# EasyEDA Pro project Designs.eprj, schematic Schematic3_3
Board Name: Registers; Create Date: 2026-04-14; Page Name: P1; Project Name: Designs; Schematic Name: Schematic3_3; Update Date: 2026-04-26; Company: EasyEDA.com; Page Size: A4; Version: V1.0
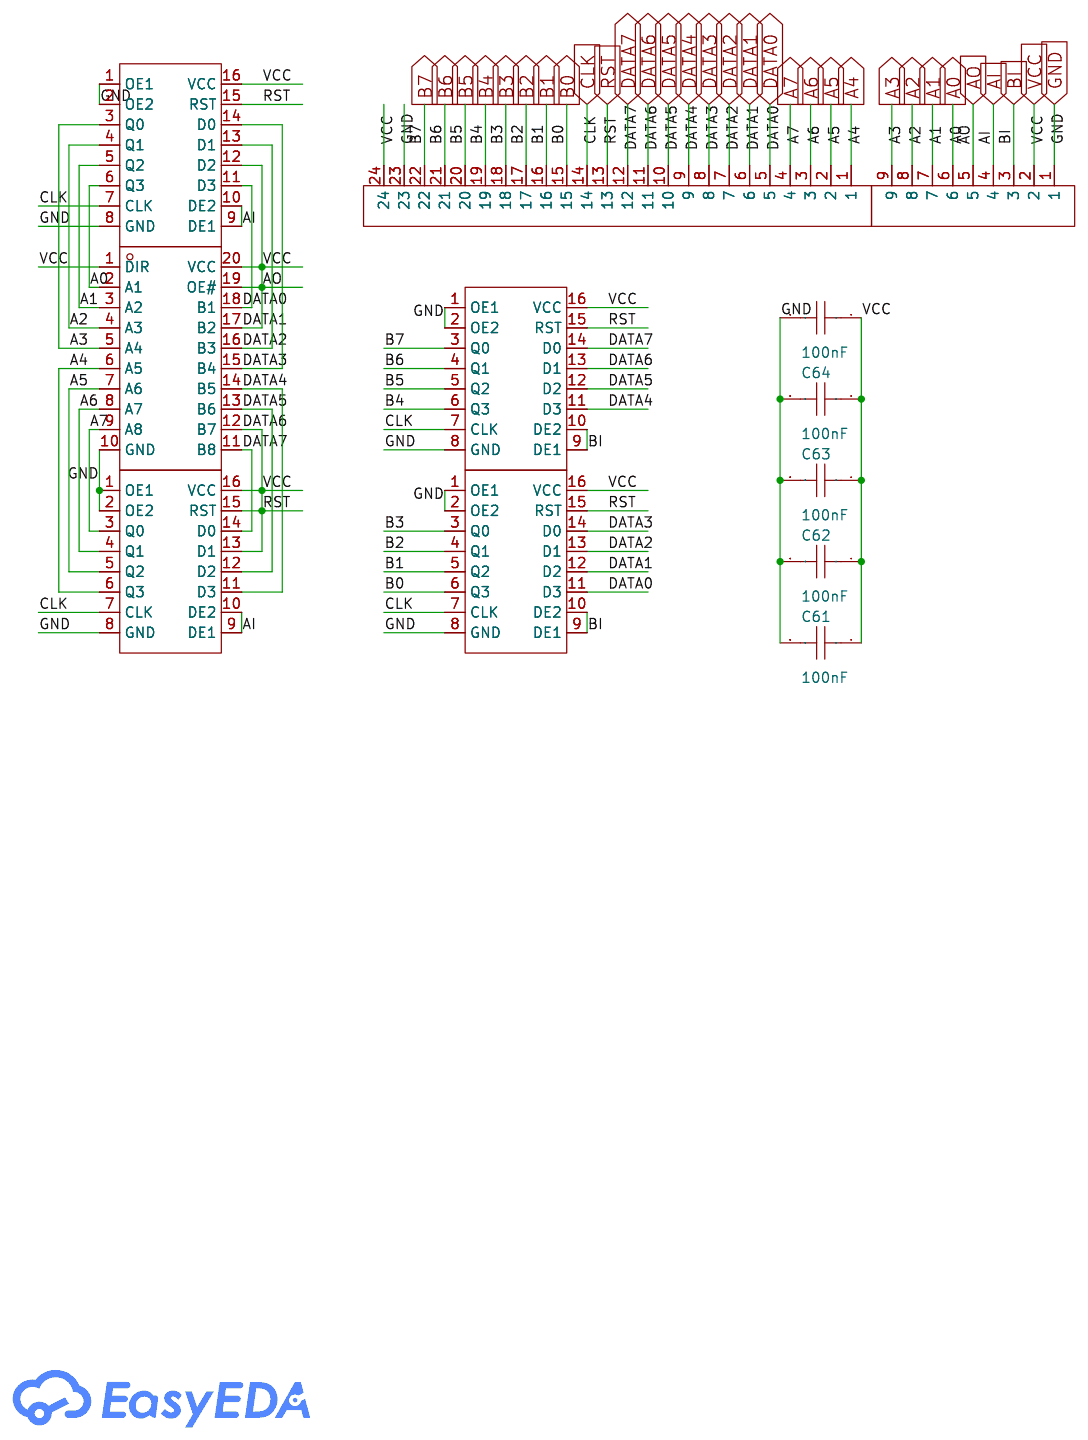
[diagram p3: schematic sheet]

## Parts
C61  100nF  [CAP-TH_L5.0-W2.5-P5.00-D1.0]
C62  100nF  [CAP-TH_L5.0-W2.5-P5.00-D1.0]
C63  100nF  [CAP-TH_L5.0-W2.5-P5.00-D1.0]
C64  100nF  [CAP-TH_L5.0-W2.5-P5.00-D1.0]
C65  100nF  [CAP-TH_L5.0-W2.5-P5.00-D1.0]
U5  SN74HC245N3  [PDIP-20_L25.9-W6.6-P2.54-LS7.9-BL]
U6  CD74HC173E  [PDIP-16_L19.2-W6.6-P2.54-LS7.6-BL]
U7  CD74HC173E  [PDIP-16_L19.2-W6.6-P2.54-LS7.6-BL]
U8  CD74HC173E  [PDIP-16_L19.2-W6.6-P2.54-LS7.6-BL]
U9  CD74HC173E  [PDIP-16_L19.2-W6.6-P2.54-LS7.6-BL]
U384  TH2.54-24P排针(母)(邮寄专用)  [HDR-TH_24P-P2.54-V-F]
U390  HDR2.54-LI-9P  [HDR-TH_9P-P2.54-V-M]

## Library data of the parts
C61-C65 = 178MU0006: LCSC Part Name: 100nF ±10% 50V; Supplier Part: C5632430; Manufacturer: KNSCHA(科尼盛); Supplier Footprint: 插件,P=2.54mm; JLCPCB Part Class: Extended Part; Datasheet: https://item.szlcsc.com/datasheet/178MU0006/6552585.html; Supplier: LCSC; Tolerance: ±10%; Voltage Rating: 50V; Temperature Coefficient: X7R; Pin Spacing: 2.54mm
U5 = SN74HC245N3: Supplier Part: C3587488; Manufacturer: TI(德州仪器); Supplier Footprint: PDIP-20; JLCPCB Part Class: Extended Part; Datasheet: https://item.szlcsc.com/datasheet/SN74HC245N3/4154202.html; Supplier: LCSC; output type: Tri-State; Voltage - Supply: 2V~6V; Number of Elements: 1; Number of Bits per Element: 8; Channel Type: Bidirectional; Current - Output Low(IOL): 7.8mA; Current - Output High(IOH): 7.8mA; Logic Family: 74HC; Operating Temperature: -40℃~+85℃; Quiescent Current: 80uA; Propagation Delay: 21ns@4.5V,50pF
U6-U9 = CD74HC173E: LCSC Part Name: 三态高速CMOS逻辑四路D型触发器; Supplier Part: C1549968; Manufacturer: TI(德州仪器); Supplier Footprint: PDIP-16; JLCPCB Part Class: Extended Part; Datasheet: https://www.ti.com/cn/lit/gpn/cd74hct173; Supplier: LCSC; Type: D-Type; Trigger Type: Rising Edge; Voltage - Supply: 2V~6V; Clock Frequency: 60MHz; Function: Reset; Number of Elements: 1; Number of Bits per Element: 4; Output Type: Tri-State; Propagation Delay: 34ns@6V,50pF; Series: 74HC Series; Current - Output Low(IOL): 7.8mA; Current - Output High(IOH): 7.8mA; Quiescent Current: 8uA; Input Capacitance: 10pF; Operating Temperature: -55℃~+125℃; Setup Time: 12ns; Hold Time: 3ns
U384 = TH2.54-24P排针(母)(邮寄专用): Supplier Part: C9900014057; Supplier Footprint: HDR-TH_24P-P2.54-V-M; JLCPCB Part Class: Extended Part; Supplier: LCSC
U390 = HDR2.54-LI-9P: Supplier Part: C9900020142; JLCPCB Part Class: Extended Part; Supplier: LCSC

## Nets
GND: C61.2 C62.2 C63.2 C64.2 C65.2 U5.10(GND) U6.1(OE1) U6.2(OE2) U6.8(GND) U7.1(OE1) U7.2(OE2) U7.8(GND) U8.1(OE1) U8.2(OE2) U8.8(GND) U9.1(OE1) U9.2(OE2) U9.8(GND) U384.23 U390.1
VCC: C61.1 C62.1 C63.1 C64.1 C65.1 U5.1(DIR) U5.20(VCC) U6.16(VCC) U7.16(VCC) U8.16(VCC) U9.16(VCC) U384.24 U390.2
A0: U5.2(A1) U7.6(Q3) U390.6
A1: U5.3(A2) U7.5(Q2) U390.7
A2: U5.4(A3) U7.4(Q1) U390.8
A3: U5.5(A4) U7.3(Q0) U390.9
A4: U5.6(A5) U6.6(Q3) U384.1
A5: U5.7(A6) U6.5(Q2) U384.2
A6: U5.8(A7) U6.4(Q1) U384.3
A7: U5.9(A8) U6.3(Q0) U384.4
AI: U6.9(DE1) U6.10(DE2) U7.9(DE1) U7.10(DE2) U390.4
AO: U5.19(OE#) U390.5
B0: U9.6(Q3) U384.15
B1: U9.5(Q2) U384.16
B2: U9.4(Q1) U384.17
B3: U9.3(Q0) U384.18
B4: U8.6(Q3) U384.19
B5: U8.5(Q2) U384.20
B6: U8.4(Q1) U384.21
B7: U8.3(Q0) U384.22
BI: U8.9(DE1) U8.10(DE2) U9.9(DE1) U9.10(DE2) U390.3
CLK: U6.7(CLK) U7.7(CLK) U8.7(CLK) U9.7(CLK) U384.14
DATA0: U5.18(B1) U7.11(D3) U9.11(D3) U384.5
DATA1: U5.17(B2) U7.12(D2) U9.12(D2) U384.6
DATA2: U5.16(B3) U7.13(D1) U9.13(D1) U384.7
DATA3: U5.15(B4) U7.14(D0) U9.14(D0) U384.8
DATA4: U5.14(B5) U6.11(D3) U8.11(D3) U384.9
DATA5: U5.13(B6) U6.12(D2) U8.12(D2) U384.10
DATA6: U5.12(B7) U6.13(D1) U8.13(D1) U384.11
DATA7: U5.11(B8) U6.14(D0) U8.14(D0) U384.12
RST: U6.15(RST) U7.15(RST) U8.15(RST) U9.15(RST) U384.13
